# EasyEDA Pro project Iot-Whgm5开发板.eprj, schematic Schematic1

## Sheets
1 P1: Create Date: 2024-05-17; Page Name: P1.Schematic1; Project Name: Iot-Whgm5开发板; Schematic Name: Schematic1; Update Date: 2024-06-14; Company: 嘉立创EDA; Drawed: 潘世俊; Page Size: A4; Version: V1.0
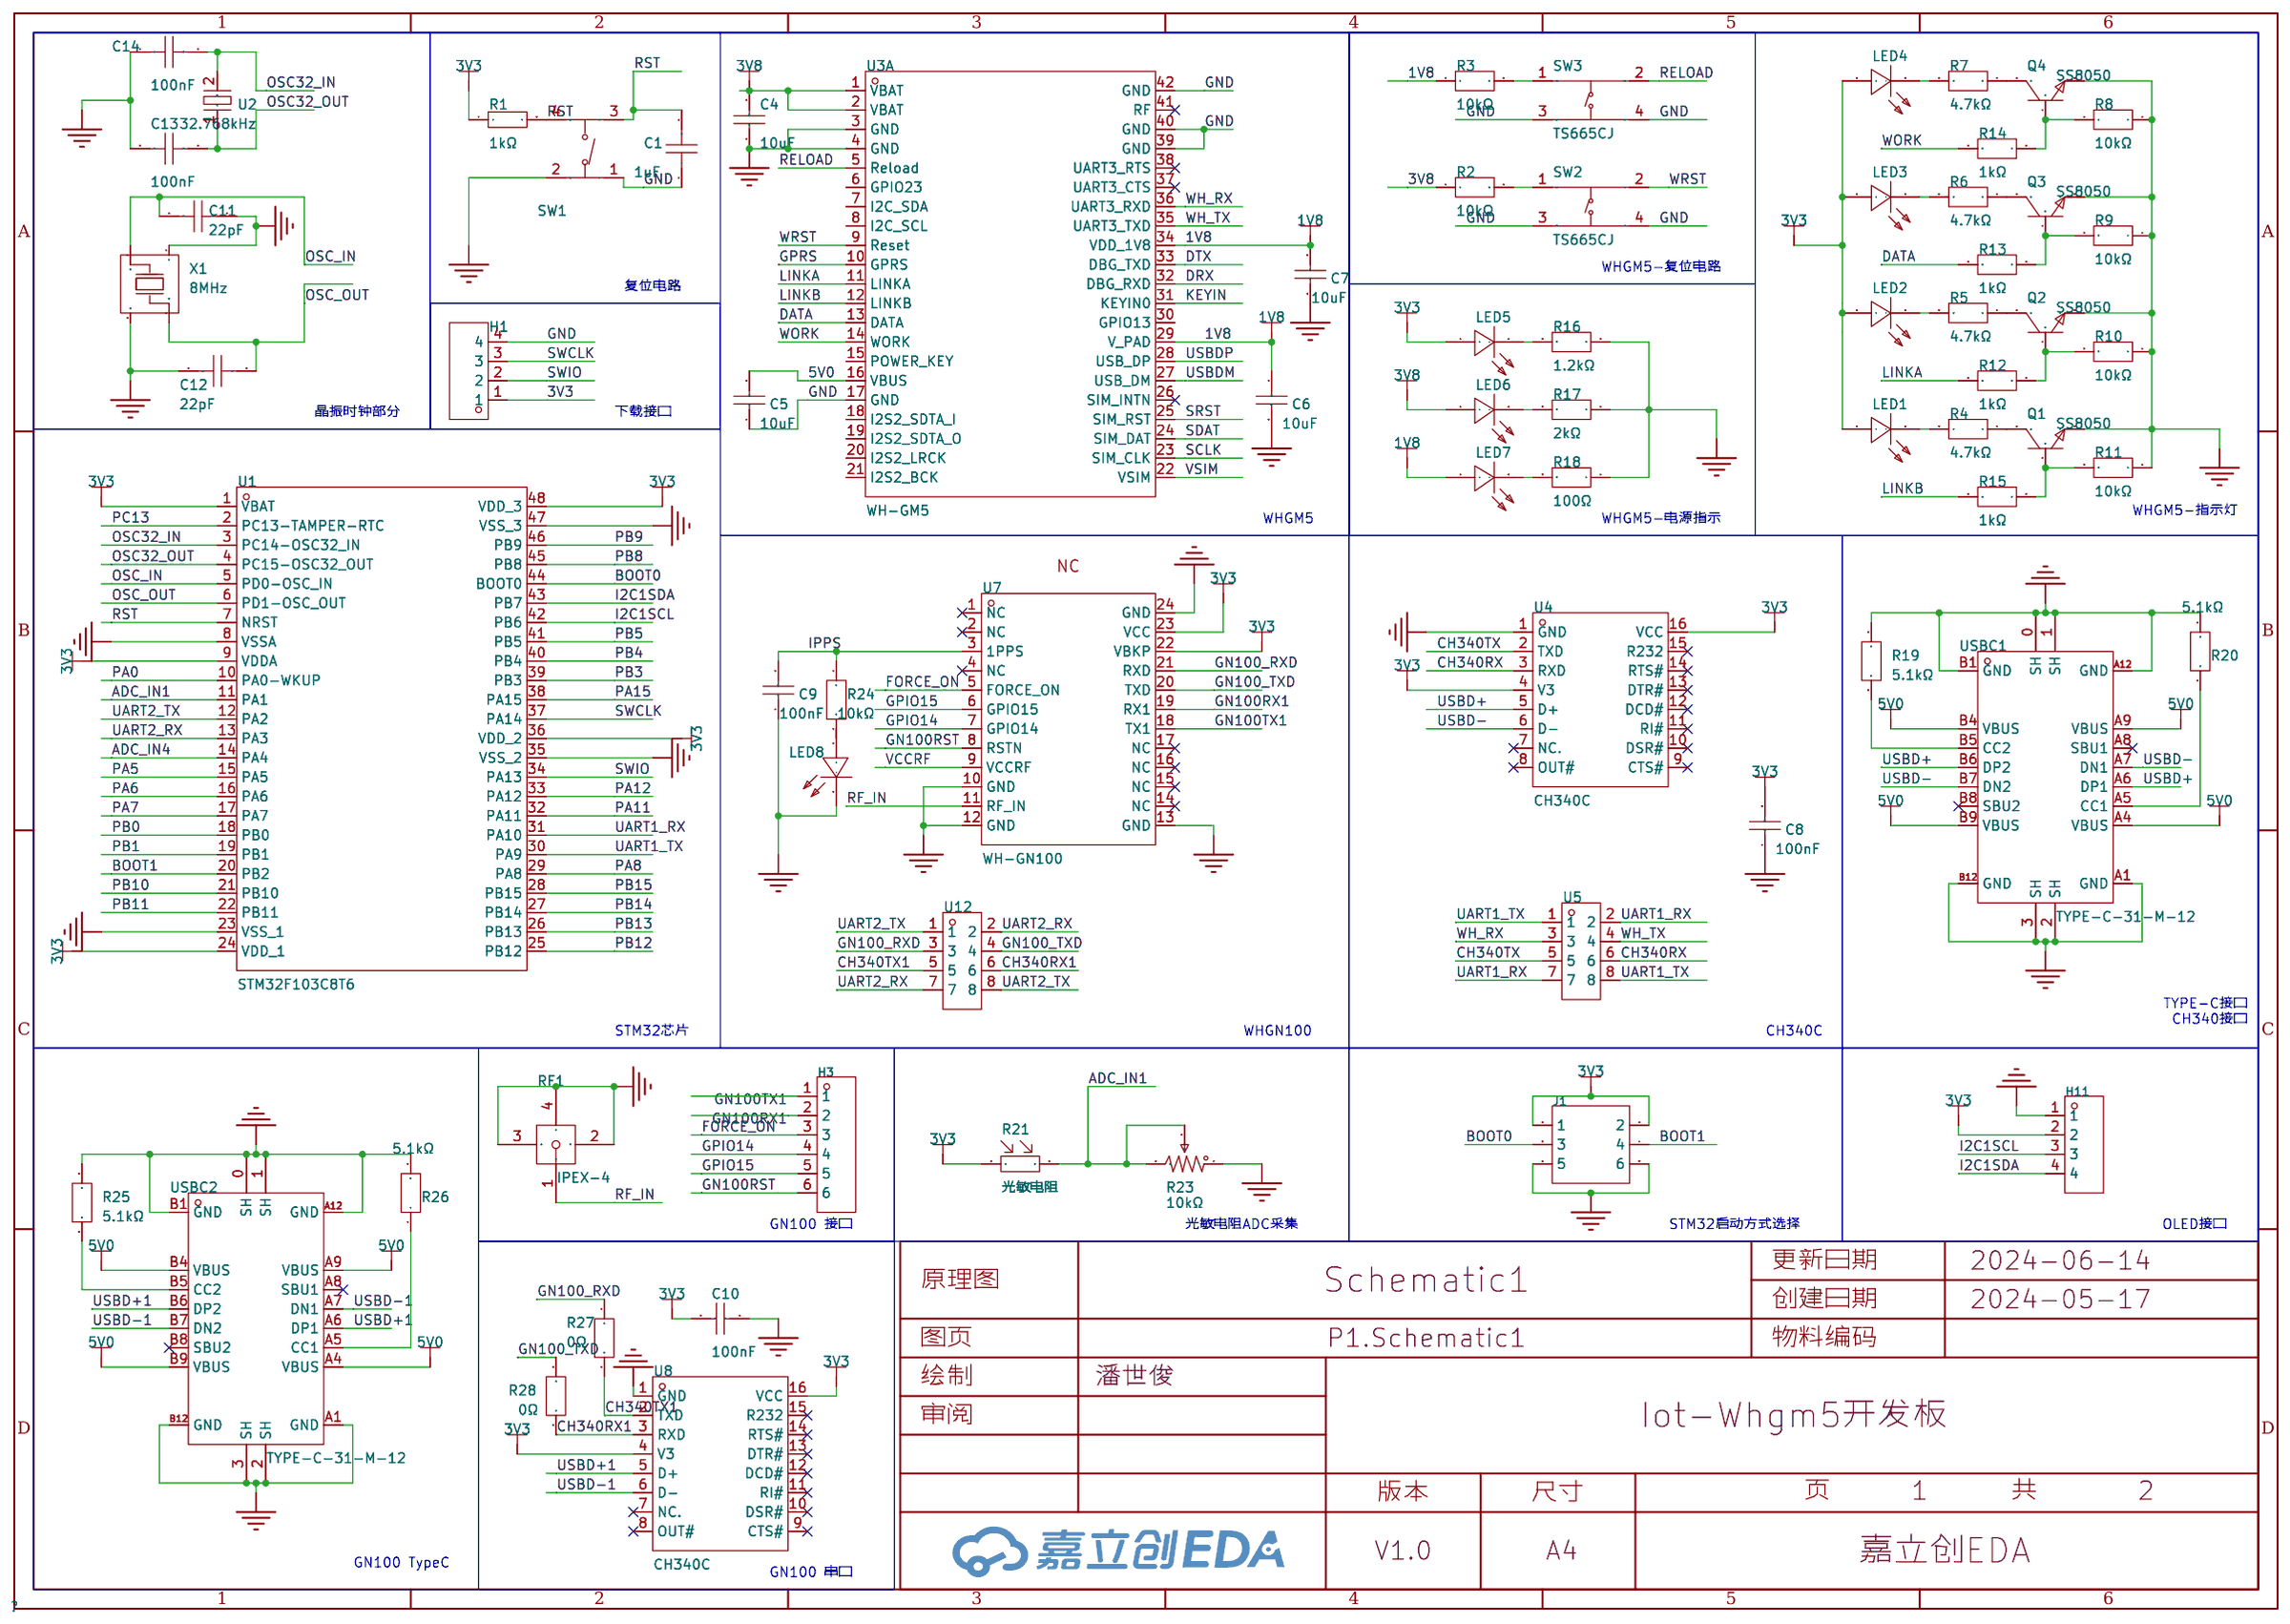
[diagram p0: P1]
2 P2: Page Name: P2.Schematic1; Update Date: 2024-05-18
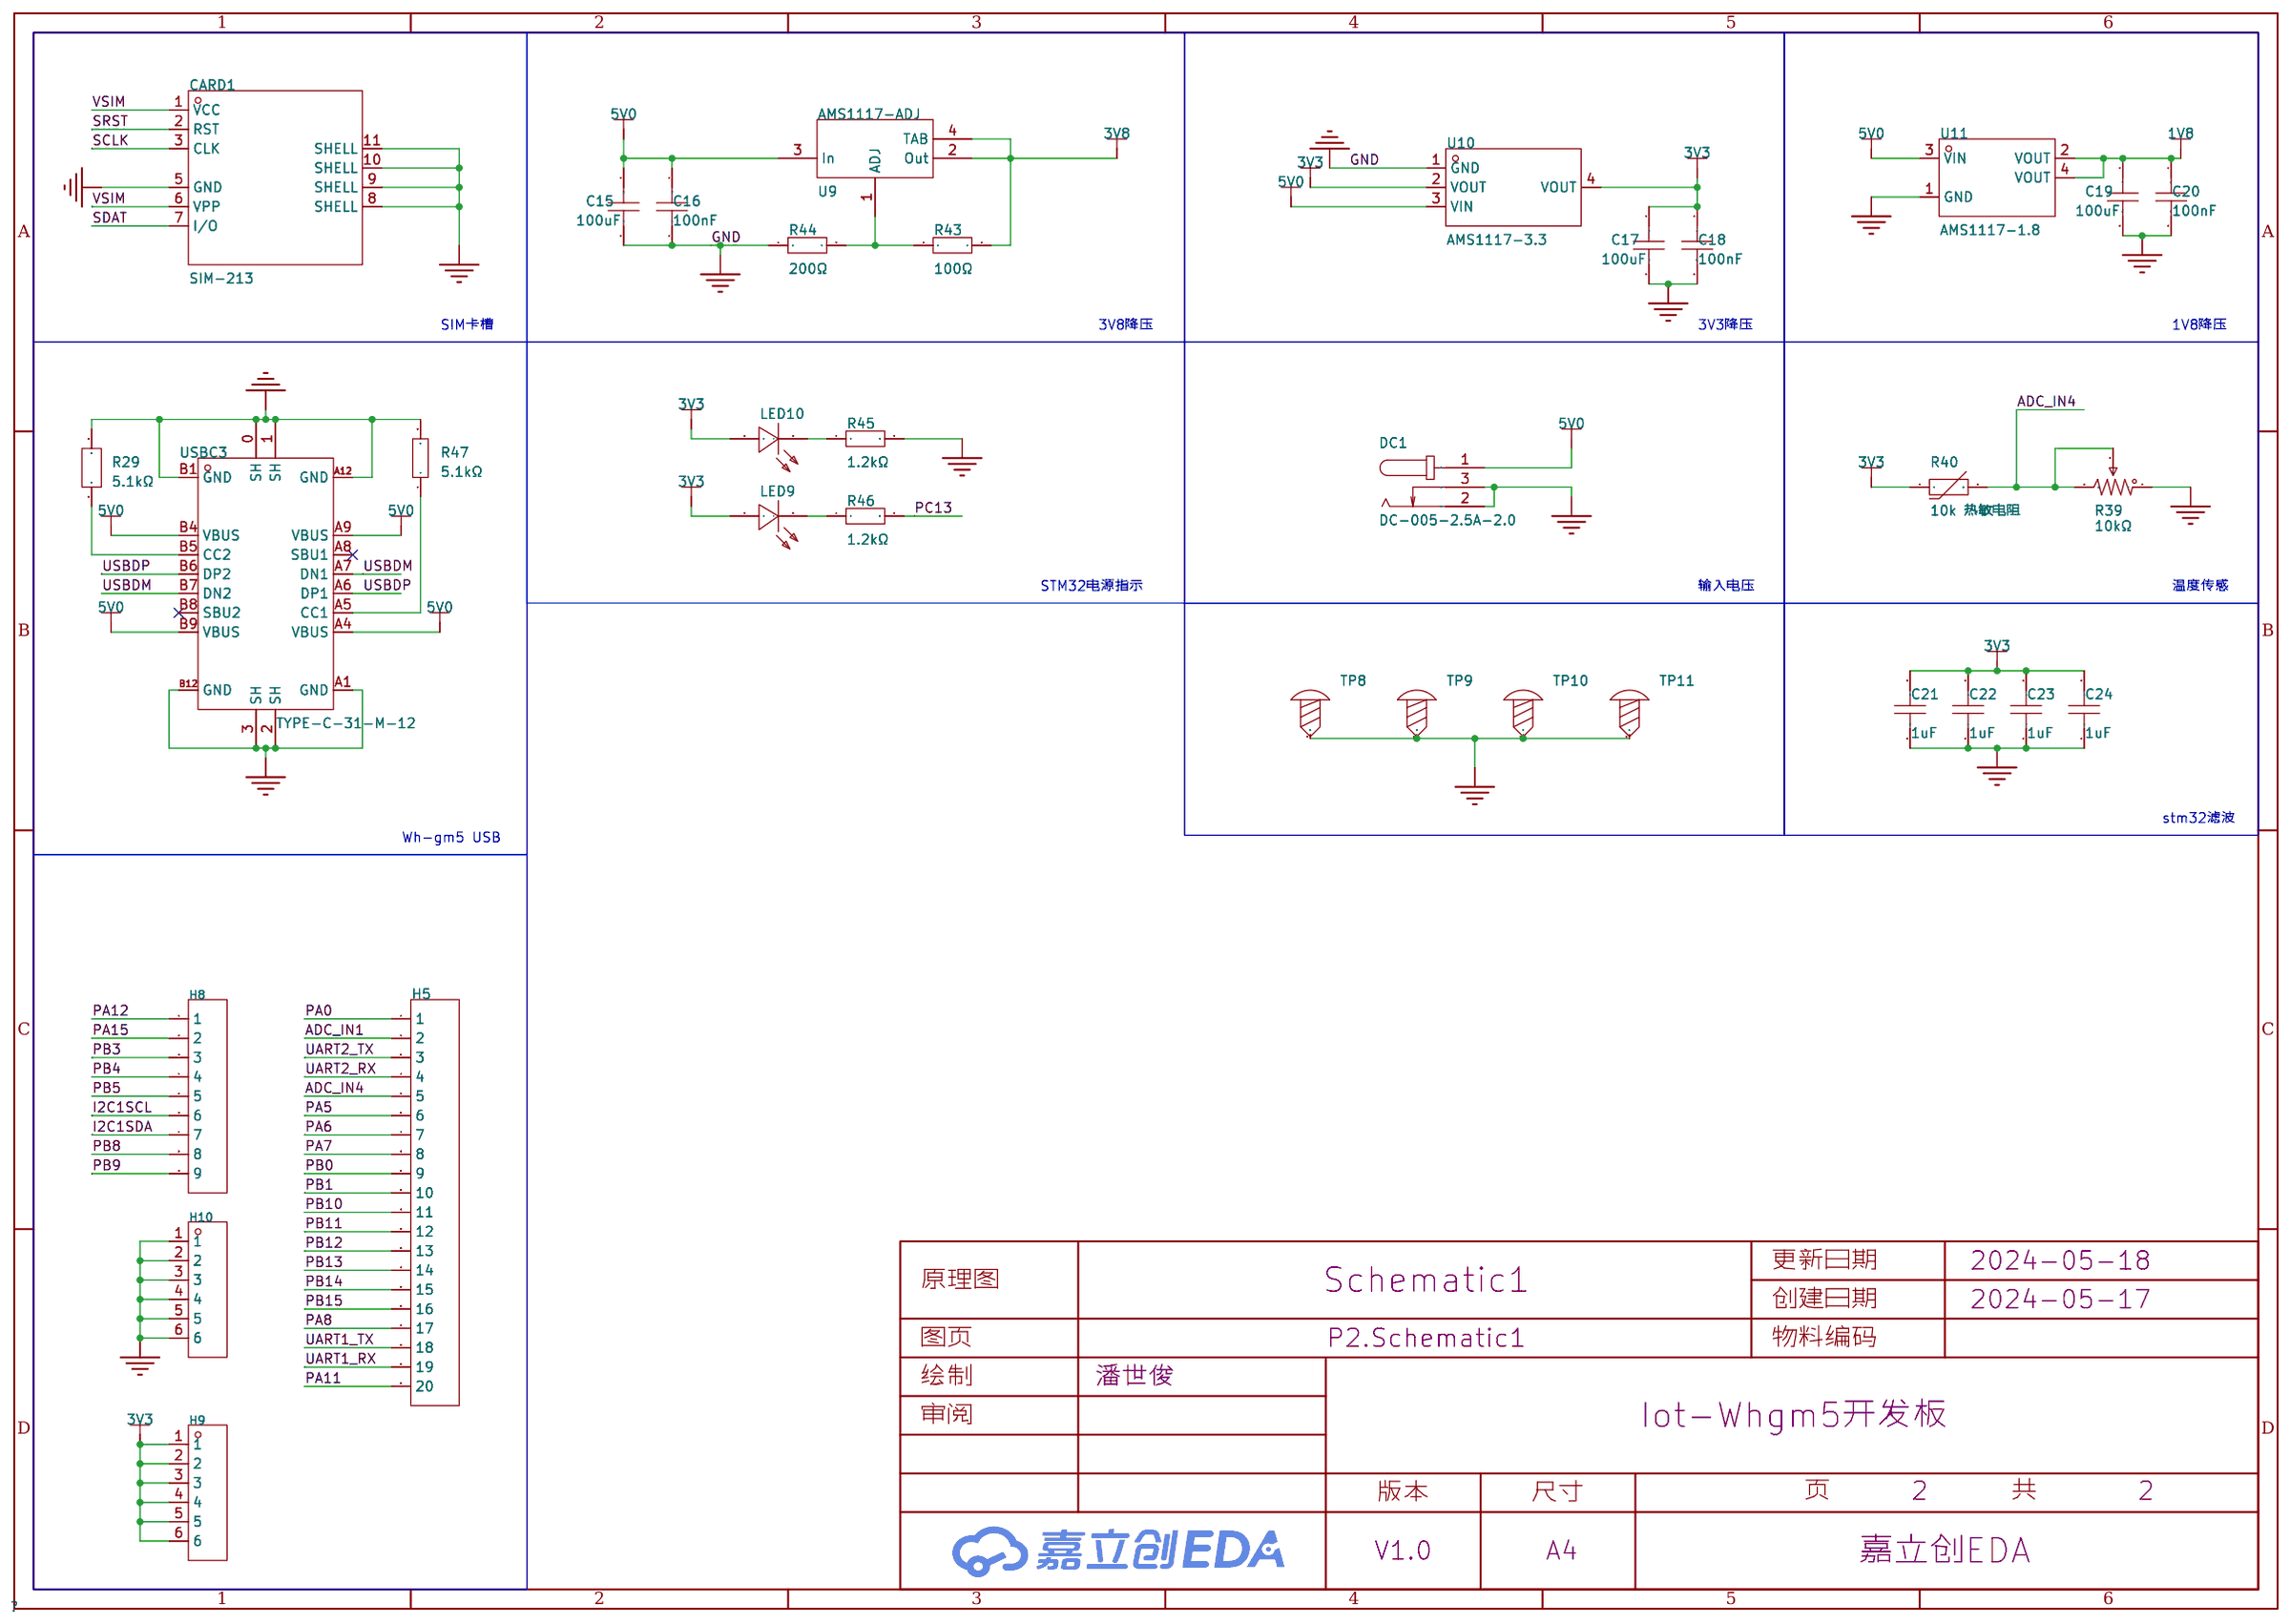
[diagram p1: P2]

## Parts
sheet P1
C1  1uF  [C0805]
C4  10uF  [D0805]
C5  10uF  [D0805]
C6  10uF  [D0805]
C7  10uF  [D0805]
C8  100nF  [D0805]
C9  100nF  [D0805]
C10  100nF  [D0805]
C11  22pF  [C0805]
C12  22pF  [C0805]
C13  100nF  [C0805]
C14  100nF  [C0805]
H1  PZ254V-11-04P  [HDR-TH_4P-P2.54-V-M]
H3  -  [HDR-TH_6P-P2.54-V-F]
H11  -  [HDR-TH_4P-P2.54-V-F]
J1  2.54-2*3P针  [HDR-TH_6P-P2.54-V-M-R2-C3-S2.54-1]
LED1  NCD0805R1  [LED0805-R-RD]
LED2  NCD0805R1  [LED0805-R-RD]
LED3  NCD0805R1  [LED0805-R-RD]
LED4  NCD0805R1  [LED0805-R-RD]
LED5  NCD0805R1  [LED0805-R-RD]
LED6  NCD0805R1  [LED0805-R-RD]
LED7  NCD0805R1  [LED0805-R-RD]
LED8  NCD0805R1  [LED0805-R-RD]
Q1  SS8050  [SOT-23-3_L2.9-W1.3-P1.90-LS2.4-BR]
Q2  SS8050  [SOT-23-3_L2.9-W1.3-P1.90-LS2.4-BR]
Q3  SS8050  [SOT-23-3_L2.9-W1.3-P1.90-LS2.4-BR]
Q4  SS8050  [SOT-23-3_L2.9-W1.3-P1.90-LS2.4-BR]
R1  1kΩ  [R0805]
R2  10kΩ  [R0805]
R3  10kΩ  [R0805]
R4  4.7kΩ  [R0805]
R5  4.7kΩ  [R0805]
R6  4.7kΩ  [R0805]
R7  4.7kΩ  [R0805]
R8  10kΩ  [R0805]
R9  10kΩ  [R0805]
R10  10kΩ  [R0805]
R11  10kΩ  [R0805]
R12  1kΩ  [R0805]
R13  1kΩ  [R0805]
R14  1kΩ  [R0805]
R15  1kΩ  [R0805]
R16  1.2kΩ  [R0805]
R17  2kΩ  [R0805]
R18  100Ω  [R0805]
R19  5.1kΩ  [R0805]
R20  5.1kΩ  [R0805]
R21  光敏电阻  [RES-TH_L5.1-W4.3-P3.40-D0.5]
R23  10kΩ  [RES-ADJ-SMD_3P-L3.0-W3.8-P1.75-BR]
R24  10kΩ  [R0805]
R25  5.1kΩ  [R0805]
R26  5.1kΩ  [R0805]
R27  0Ω  [R0805]
R28  0Ω  [R0805]
RF1  IPEX-4  [IPEX-SMD_4P-L1.8-W1.7-LS2.0]
SW1  TS-1187A-B-A-B  [SW-SMD_4P-L5.1-W5.1-P3.70-LS6.5-TL-2]
SW2  TS665CJ  [SW-TH_4P-L6.0-W6.0-P4.50-LS6.5]
SW3  TS665CJ  [SW-TH_4P-L6.0-W6.0-P4.50-LS6.5]
U1  STM32F103C8T6  [LQFP-48_L7.0-W7.0-P0.50-LS9.0-BL]
U2  32.768kHz  [CRYSTAL-SMD_L3.2-W1.5-1]
U3  WH-GM5  [LCC-LGA-81_L28.1-W24.5-P1.27-TL]  (section 1)
U4  CH340C  [SOP-16_L10.0-W3.9-P1.27-LS6.0-BL]
U5  PZ2.54-2*4  [HDR-TH_8P-P2.54-V-M-R2-C4-S2.54]
U7  WH-GN100  [GPSM-SMD_WH-GN100]
U8  CH340C  [SOP-16_L10.0-W3.9-P1.27-LS6.0-BL]
U12  PZ2.54-2*4  [HDR-TH_8P-P2.54-V-M-R2-C4-S2.54]
USBC1  TYPE-C-31-M-12  [USB-C_SMD-TYPE-C-31-M-12]
USBC2  TYPE-C-31-M-12  [USB-C_SMD-TYPE-C-31-M-12]
X1  8MHz  [OSC-SMD_4P-L3.2-W2.5-BL]
sheet P2
C15  100uF  [C0805]
C16  100nF  [C0805]
C17  100uF  [C0805]
C18  100nF  [C0805]
C19  100uF  [C0805]
C20  100nF  [C0805]
C21  1uF  [C0805]
C22  1uF  [C0805]
C23  1uF  [C0805]
C24  1uF  [C0805]
CARD1  SIM-213  [SIM-SMD_SIM-213_C2836124]
DC1  DC-005-2.5A-2.0  [CONN-TH_DC-005-2.5A-2.0]
H5  -  [HDR-TH_20P-P2.54-V-F]
H8  -  [HDR-TH_9P-P2.54-V-F-1]
H9  -  [HDR-TH_6P-P2.54-V-F]
H10  -  [HDR-TH_6P-P2.54-V-F]
LED9  NCD0805R1  [LED0805-R-RD]
LED10  NCD0805R1  [LED0805-R-RD]
R29  5.1kΩ  [R0805]
R39  10kΩ  [RES-ADJ-SMD_3P-L3.0-W3.8-P1.75-BR]
R40  10k 热敏电阻  [R0805]
R43  100Ω  [R0805]
R44  200Ω  [R0805]
R45  1.2kΩ  [R0805]
R46  1.2kΩ  [R0805]
R47  5.1kΩ  [R0805]
TP8  -  [M2螺丝]
TP9  -  [M2螺丝]
TP10  -  [M2螺丝]
TP11  -  [M2螺丝]
U9  AMS1117-ADJ  [SOT-223_L6.7-W3.5-P2.30-BR]
U10  AMS1117-3.3  [SOT-223-3_L6.5-W3.4-P2.30-LS7.0-BR]
U11  AMS1117-1.8  [SOT-223-3_L6.7-W3.7-P2.30-LS7.0-BR]
USBC3  TYPE-C-31-M-12  [USB-C_SMD-TYPE-C-31-M-12]

## Library data of the parts
C1 = CC0805KRX7R9BB103: 容值:10nF;精度:±10%;额定电压:50V;材质(温度系数):X7R;; LCSC Part Name: 10nF ±10% 50V; Supplier Part: C83170; Manufacturer: YAGEO(国巨); Supplier Footprint: 0805; JLCPCB Part Class: 扩展库; Datasheet: https://atta.szlcsc.com/upload/public/pdf/source/20170211/1486785656773.pdf; Supplier: LCSC; Tolerance: ±10%; Voltage Rated: 50V; Temperature Coefficient: X7R
C4-C10 = CL31A106KBHNNNE: 容值:10uF;精度:±10%;额定电压:50V;材质(温度系数):X5R;; LCSC Part Name: 10uF ±10% 50V; Supplier Part: C13585; Manufacturer: SAMSUNG(三星); Supplier Footprint: 1206; JLCPCB Part Class: 基础库; Datasheet: https://atta.szlcsc.com/upload/public/pdf/source/20160218/1457707763339.pdf; Supplier: LCSC; Tolerance: ±10%; Voltage Rated: 50V; Temperature Coefficient: X5R
C11-C24 = CAP_0805: Supplier Footprint: 0805
H1 = PZ254V-11-04P: 插针结构:1x4P;间距:2.54mm;行距:-;圆针/方针:方针;安装类型:直插;排数:单排;总PIN位数:4P;额定电流:3A;额定电压:250V;配合针长度:6mm;塑高:2.5mm;端接针长度:3mm;触头材质:-;工作温度范围:-40℃~+105℃;颜色:黑色;; LCSC Part Name: 间距:2.54mm 1x4P 直插 方针; Supplier Part: C2691448; Manufacturer: XFCN(兴飞); Supplier Footprint: 插件,P=2.54mm; JLCPCB Part Class: 扩展库; Datasheet: https://atta.szlcsc.com/upload/public/pdf/source/20200309/C492403_F9F19131791D08044AD4F84F8E751A34.pdf; Supplier: LCSC; Pin Structure: 1x4P; Pitch: 2.54mm; Circluar Pins/Square Pins: 方针; Mounting Type: 直插; Number of Rows: 单排; Number of Pins: 4P; Current Rating (Max): 3A; Voltage Rating (Max): 250V; Length of Mating Pin: 6mm; Insulation Height: 2.5mm; Length of End Connection Pin: 3mm; Operating Temperature Range: -40℃~+105℃; Color: 黑色
H3 H9 H10 = HDR-F_2.54_1x6P: Supplier Part: C40877; Supplier Footprint: 插件
H11 = HDR-F_2.54_1x4P: Supplier Part: C2718488; Supplier Footprint: 插件
J1 = 2.54-2*3P针: 插针结构:-;间距:2.54mm;行距:-;圆针/方针:-;安装类型:直插;排数:双排;总PIN位数:6P;额定电流:-;额定电压:-;配合针长度:-;塑高:-;触头材质:-;触头镀层:-;颜色:黑色;; LCSC Part Name: 间距:2.54mm 直插; Supplier Part: C65114; Manufacturer: BOOMELE(博穆精密); Supplier Footprint: 插件,P=2.54mm; JLCPCB Part Class: 扩展库; Supplier: LCSC; Pitch: 2.54mm; Mounting Type: 直插; Number of Rows: 双排; Number of Pins: 6P; Color: 黑色
LED1-LED10 = NCD0805R1: 灯头类型:-;发光颜色:红色;正向电压(VF):1.6V~2.6V;功率:65mW;正向电流:20mA;主波长:615nm~630nm;二极管配置:独立二极管;透镜颜色:无色透明透镜;色温:-;发光强度:67mcd~195mcd;发光角度:130°;载带方式:-;工作温度:-30℃~+85℃;; Supplier Part: C84256; Manufacturer: 国星光电; Supplier Footprint: 0805; JLCPCB Part Class: 基础库; Datasheet: https://atta.szlcsc.com/upload/public/pdf/source/20200820/C84256_F0A75A43B3EAD75808600A0514C76B99.pdf; Supplier: LCSC; Emitted Color: 红色; Forward Voltage (VF): 1.6V~2.6V; Power Dissipation: 65mW; Forward Current: 20mA; Dominant Wavelength: 615nm~630nm; Diode Configuration: 独立二极管; Lens Color: 无色透明透镜; Luminous Intensity: 67mcd~195mcd; Viewing Angle: 130°; Operating Temperature: -30℃~+85℃
Q1-Q4 = SS8050_C2150: 晶体管类型:NPN;集电极电流(Ic):1.5A;集射极击穿电压(Vceo):25V;功率(Pd):300mW;直流电流增益(hFE@Ic,Vce):200@100mA,1V;; LCSC Part Name: SS8050(RANGE:200-350) hfe=200~350; Supplier Part: C2150; Manufacturer: CJ(江苏长电/长晶); Supplier Footprint: SOT-23; JLCPCB Part Class: 基础库; Datasheet: https://atta.szlcsc.com/upload/public/pdf/source/20230322/AEE86F4B043774EFF80CAEA14A37D9E9.pdf; Supplier: LCSC; Transistor Type: NPN; Collector Current (Ic): 1.5A; Collector-Emitter Breakdown Voltage (Vceo): 25V; Power Dissipation (Pd): 300mW; DC Current Gain (hFE@Ic,Vce): 200@100mA,1V; Transition Frequency (fT): 100MHz; Collector Cut-Off Current (Icbo): 100nA; Collector-Emitter Saturation Voltage (VCE(sat)@Ic,Ib): 500mV@800mA,80mA
R1 = RC0603FR-071KL: 电阻类型:厚膜电阻;阻值:1kΩ;精度:±1%;功率:100mW;最大工作电压:75V;温度系数:±100ppm/℃;; LCSC Part Name: 厚膜电阻 1kΩ ±1% 100mW; Supplier Part: C22548; Manufacturer: YAGEO(国巨); Supplier Footprint: 0603; JLCPCB Part Class: 扩展库; Datasheet: https://atta.szlcsc.com/upload/public/pdf/source/20180316/70C0E2BDAE7FCC62C531A5A58D202EE1.pdf; Supplier: LCSC; Type: 厚膜电阻; Tolerance: ±1%; Power(Watts): 100mW; Overload Voltage (Max): 75V; Temperature Coefficient: ±100ppm/℃; Operating Temperature Range: -55℃~+155℃
R2-R20 R24-R29 = MF1/4W-10K±1%-ST52: 电阻类型:金属膜电阻;阻值:10kΩ;精度:±1%;功率:250mW;温度系数:±100ppm/℃;; LCSC Part Name: 金属膜电阻 10kΩ ±1% 250mW; Supplier Part: C2903232; Manufacturer: VO(翔胜); Supplier Footprint: 插件,2.7x6.2mm; JLCPCB Part Class: 扩展库; Datasheet: https://atta.szlcsc.com/upload/public/pdf/source/20200609/C601728_5AA4C0C8E12E11069DA2C3356F29D1F2.pdf; Supplier: LCSC; Type: 金属膜电阻; Tolerance: ±1%; Overload Voltage (Max): 250V; Power(Watts): 250mW; Temperature Coefficient: ±100ppm/℃; Operating Temperature Range: -55℃~+155℃
R21 = GL5528(10-20)_C10081: 暗电阻:1MΩ;亮电阻 @ 10Lux:10kΩ~20kΩ;光谱峰值(波长):540nm;; LCSC Part Name: 亮电阻:10kΩ~20kΩ 暗电阻:1MΩ; Supplier Part: C10081; Manufacturer: JCHL(晶创和立); Manufacturer Part: GL5528(10-20); Supplier Footprint: 插件,P=3.4mm; JLCPCB Part Class: 扩展库; Datasheet: https://atta.szlcsc.com/upload/public/pdf/source/20200417/C515010_C10502EF7F431E893A7F20DB83F527F0.pdf; Supplier: LCSC; Dark Resistance: 1MΩ; Illuminated Resistance @ 10Lux: 10kΩ~20kΩ; Applied Voltage: 150V; Spectral Peak: 540nm
R23 R39 = TC33X-2-103E: 阻值:10kΩ;精度:±25%;功率:150mW;温度系数:±250ppm/℃;; LCSC Part Name: 10kΩ ±25%; Supplier Part: C719176; Manufacturer: BOURNS; Supplier Footprint: SMD; JLCPCB Part Class: 扩展库; Datasheet: https://atta.szlcsc.com/upload/public/pdf/source/20200810/C720646_BB66A75E654D5E1D30127FF45BCD3C26.pdf; Supplier: LCSC; Tolerance: ±25%; Power(Watts): 150mW; Temperature Coefficient: ±250ppm/℃; Turns: 1
RF1 = IPEX-4: 射频系列:IPEX;; LCSC Part Name: IPEX; Supplier Part: C2987683; Manufacturer: Ziisor(致哲); Supplier Footprint: SMD; JLCPCB Part Class: 扩展库; Datasheet: https://atta.szlcsc.com/upload/public/pdf/source/20220330/D1F8CE2CB9E7BFF3BB2C4079325448CF.pdf; Supplier: LCSC; RF Series: IPEX
SW1 = TS-1187A-B-A-B: 电路结构:单刀单掷;按钮形状:圆形按钮;作用力:160gf;安装方式:立贴;开关长度:5.1mm;开关宽度:5.1mm;开关高度:1.5mm;带支架:不带;触点电流:50mA;额定电压(DC):12V;绝缘电阻:-;带灯:无;机械寿命:10万次;; LCSC Part Name: 5.1*5.1*1.5mm 立贴 轻触开关; Supplier Part: C318884; Manufacturer: XKB Connectivity(中国星坤); Supplier Footprint: SMD; JLCPCB Part Class: 基础库; Datasheet: https://atta.szlcsc.com/upload/public/pdf/source/20200227/C318890_053E50208A88A7BA1965D8746000774E.pdf; Supplier: LCSC; Circuit: 单刀单掷; Actuator Style: 圆形按钮; Operating Force: 160gf; Mounting Style: 立贴; Switch Length: 5.1mm; Switch Width: 5.1mm; Switch Height: 1.5mm; Strike Gundam: 不带; Contact Current: 50mA; Voltage Rating (DC): 12V; Actuator/Cap Color: 金色; With Lamp: 无; Mechanical Life: 10万次; Operating Temperature: -30℃~+85℃
SW2 SW3 = TS665CJ: 电路结构:单刀单掷;按钮形状:圆形按钮;安装方式:直插;开关长度:6mm;开关宽度:6mm;开关高度:5mm;触点电流:50mA;额定电压(DC):12V;带灯:-;机械寿命:-;; LCSC Part Name: 6*6*5mm 直插 轻触开关; Supplier Part: C393938; Manufacturer: SHOU HAN(首韩); Supplier Footprint: 插件; JLCPCB Part Class: 扩展库; Datasheet: https://atta.szlcsc.com/upload/public/pdf/source/20190521/C393938_BDABEAC600B4C55E200A80AA129B70BC.pdf; Supplier: LCSC; Circuit: 单刀单掷; Actuator Style: 圆形按钮; Mounting Style: 直插; Switch Length: 6mm; Switch Width: 6mm; Switch Height: 5mm; Contact Current: 50mA; Voltage Rating (DC): 12V
U1 = STM32F103C8T6: CPU内核:ARM-M3;程序存储容量:64KB;RAM总容量:20KB;GPIO端口数量:37;工作电压范围:2V~3.6V;CPU最大主频:72MHz;程序存储器类型:FLASH;; Supplier Part: C8734; Manufacturer: ST(意法半导体); Supplier Footprint: LQFP-48(7x7); JLCPCB Part Class: 扩展库; Datasheet: https://atta.szlcsc.com/upload/public/pdf/source/20220812/8363ACEC51AD55ECEB84799464F7CB85.pdf; Supplier: LCSC; CPU Core: ARM-M3; Program Storage Size: 64KB; RAM Size: 20KB; GPIO Ports Number: 37; Operating Voltage Range: 2V~3.6V; CPU Maximum Speed: 72MHz; Program Memory Type: FLASH; Operating Temperature Range: -40℃~+85℃; ADC (Bit): 12bit; Universal Serial Bus: 有; Peripheral/Function: 看门狗；DMA；看门狗；温度传感器; Watchdog: 有; Infrared Data Association: 有; Low-Voltage Detect: 有; Direct Memory Access: 有; Internal Oscillator: 有
U2 = H31003271C2070CY: 晶振类型:贴片晶振;频率:32.768kHz;常温频差:±20ppm;外接负载电容:12.5pF;频率稳定度(全温):±30ppm;; LCSC Part Name: 32.768kHz ±20ppm 12.5pF; Supplier Part: C5361379; Manufacturer: JGHC(晶光华); Supplier Footprint: SMD3215-2P; JLCPCB Part Class: 扩展库; Datasheet: https://atta.szlcsc.com/upload/public/pdf/source/20240223/DA6BB0D04F2F206220D58296EAF6160A.pdf; Supplier: LCSC; Crystal Type: 贴片晶振; Normal temperature Frequency Tolerance: ±20ppm; External load capacitor: 12.5pF; Frequency Stability(Full temperature range): ±30ppm; Equivalent Series Resistance (ESR): 70kΩ; Operating Temperature: -40℃~+85℃
U3 = WH-GM5_C2833613: LCSC Part Name: 提供 LCC/LGA 混合连接方式模块; Supplier Part: C2833613; Manufacturer: USR(有人物联网); JLCPCB Part Class: 扩展库; Datasheet: https://atta.szlcsc.com/upload/public/pdf/source/20210521/C2833613_BFDC8E35AC606A08B915FEA5419AEEFD.pdf; Supplier: LCSC
U4 U8 = CH340C: 应用功能:收发器;接口协议:USB 2.0;数据速率:2Mbps;; LCSC Part Name: CH340C USB转串口芯片 CH340; Supplier Part: C84681; Manufacturer: WCH(南京沁恒); Supplier Footprint: SOP-16; JLCPCB Part Class: 扩展库; Datasheet: https://atta.szlcsc.com/upload/public/pdf/source/20200819/C84681_ADBED554CE321879DBD6B1D06488689C.pdf; Supplier: LCSC; Applications Function: 收发器; Protocol: USB 2.0; Supply Voltage: 3.3V；5V; Data Rate: 2Mbps
U5 U12 = PZ2.54-2*4: 插针结构:2x4P;间距:2.54mm;排数:双排;总PIN位数:8P;; Supplier Part: C5156676; Manufacturer: ZHOURI(洲日); Supplier Footprint: 插件,P=2.54mm; JLCPCB Part Class: 扩展库; Datasheet: https://atta.szlcsc.com/upload/public/pdf/source/20220923/0E7A4A94740FFD503E2D73F36F92C1EA.pdf; Supplier: LCSC; Pin Structure: 2x4P; Pitch: 2.54mm; Number of Rows: 双排; Number of Pins: 8P
U7 = WH-GN100: Supplier Part: C9900013145; Supplier Footprint: SMD-24; JLCPCB Part Class: 扩展库; Supplier: LCSC
USBC1-USBC3 = TYPE-C-31-M-12: 连接器类型:Type-C;标准:-;公母:母;端口数量:1;触点数量:16P;安装方式:-;额定电流 - 电源:5A;触头材质:-;触头镀层:-;工作温度范围:-;焊接温度(最大值):-;; LCSC Part Name: Type-C 母; Supplier Part: C165948; Manufacturer: 韩国韩荣; Supplier Footprint: SMD; JLCPCB Part Class: 扩展库; Datasheet: https://atta.szlcsc.com/upload/public/pdf/source/20220525/466408E853115E789EDB0DDC29077C05.pdf; Supplier: LCSC; Connector Type: Type-C; Gender: 母; Number of Ports: 1; Number of Contacts: 16P; Current Rating - Power (Max): 5A
X1 = TAXM8M4RDBCCT2T: 晶振类型:贴片晶振;频率:8MHz;常温频差:±10ppm;外接负载电容:10pF;频率稳定度(全温):±15ppm;; LCSC Part Name: 8MHz ±10ppm 10pF; Supplier Part: C400090; Manufacturer: YJX(雅晶鑫); Supplier Footprint: SMD3225-4P; JLCPCB Part Class: 扩展库; Datasheet: https://atta.szlcsc.com/upload/public/pdf/source/20190626/C400090_CF95B89E745AFE4EF2E392EF8AC009D6.pdf; Supplier: LCSC; Crystal Type: 贴片晶振; Normal temperature Frequency Tolerance: ±10ppm; External load capacitor: 10pF; Frequency Stability(Full temperature range): ±15ppm; Equivalent Series Resistance (ESR): 250Ω; Operating Temperature: -40℃~+85℃
CARD1 = SIM-213_C2836124: 卡连接方式:拔插式;卡类型:MicroSIM卡;连接器类型:卡座;本体最大高度:1.5mm;触头材质:-;触头镀层:金;工作温度范围:-40℃~+85℃;焊接温度(最大值):260℃;; LCSC Part Name: 拔插式 MicroSIM卡 卡座; Supplier Part: C2836124; Manufacturer: HANBO(汉博); Supplier Footprint: SMD; JLCPCB Part Class: 扩展库; Datasheet: https://atta.szlcsc.com/upload/public/pdf/source/20230131/88FB45FA145E9CCC9FE4F43183D41841.pdf; Supplier: LCSC; Card Connection Mode: 拔插式; Card Type: MicroSIM卡; Connector Type: 卡座; Body Height (Max): 1.5mm; Contact Plating: 金; Operating Temperature Range: -40℃~+85℃; Soldering Temperature(Max): 260℃
DC1 = DC-005-2.5A-2.0: 连接器类型:DC电源插座;安装方式:面板安装;触点内径:2mm;触点外径:6.2mm;额定电流:2.5A;额定电压:24V;触头材质:黄铜;工作温度范围:-20℃~+70℃;焊接温度(最大值):260℃;; LCSC Part Name: DC电源插座 内径:2mm 外径:6.2mm; Supplier Part: C319099; Manufacturer: XKB Connection(中国星坤); Supplier Footprint: 插件; JLCPCB Part Class: 扩展库; Datasheet: https://atta.szlcsc.com/upload/public/pdf/source/20230410/3C172F25A51FCA230ABE6D36425CBB3B.pdf; Supplier: LCSC; Connector Type: DC电源插座; Mounting Style: 面板安装; Inside Contact Diameter: 2mm; Outside Contact Diameter: 6.2mm; Current Rating (Max): 2.5A; Voltage Rating (Max): 24V; Contact Material: 黄铜; Operating Temperature Range: -20℃~+70℃; Soldering Temperature(Max): 260℃
H5 = HDR-F_2.54_1x20P: Supplier Part: C50984; Supplier Footprint: 插件
H8 = HDR-F_2.54_1x9P: Supplier Part: C39576; Supplier Footprint: 插件
R40 = SDNT2012X103F3950FTF: 阻值(25℃):10kΩ;B值(25℃/50℃):3950K;电阻精度:±1%;功率:200mW;B值精度:±1%;最大稳态电流(25℃):440uA;; LCSC Part Name: 10kΩ 电阻精度:±1% 3950K; Supplier Part: C95968; Manufacturer: Sunlord(顺络); Supplier Footprint: 0805; JLCPCB Part Class: 扩展库; Datasheet: https://atta.szlcsc.com/upload/public/pdf/source/20210916/BF106A3565EDFEB141CB3E0EA3A661F8.pdf; Supplier: LCSC; Resistance @ 25℃: 10kΩ; B Constant (25℃/50℃): 3950K; Resistance Tolerance: ±1%; Power: 200mW; B Constant Tolerance: ±1%; Steady State Current (Max): 440uA; Operating Temperature: -55℃~+125℃
R43-R47 = Res_0805: Supplier Footprint: 0805
TP8-TP11 = M2螺丝: Supplier Footprint: 插件
U9 = AMS1117-ADJ_C6188: 输出类型:可调;最大输入电压:15V;输出电压:1.25V~11.75V;最大输出电流:800mA;电源纹波抑制比(PSRR):75dB@(120Hz);输出极性:正极;; LCSC Part Name: ADJ 输入15V 输出1.25V~11.75V 800mA; Supplier Part: C6188; Manufacturer: AMS; Supplier Footprint: SOT-223; JLCPCB Part Class: 扩展库; Datasheet: https://atta.szlcsc.com/upload/public/pdf/source/20120416/1457706470730.pdf; Supplier: LCSC; Output Type: 可调; Maximum Input Voltage: 15V; Output Voltage: 1.25V~11.75V; MAX Output Current: 800mA; Power Supply Rejection Ratio (PSRR): 75dB@(120Hz); Dropout Voltage: 1.3V@(800mA); Output Polarity: 正极; Number of Outputs: 1
U10 = AMS1117-3.3_C6186: 输出类型:固定;最大输入电压:-;输出电压:3.3V;最大输出电流:1A;电源纹波抑制比(PSRR):72dB@(120Hz);输出极性:正极;; LCSC Part Name: 输出3.3V 1A; Supplier Part: C6186; Manufacturer: AMS; Supplier Footprint: SOT-223-3; JLCPCB Part Class: 基础库; Datasheet: https://atta.szlcsc.com/upload/public/pdf/source/20180727/C6186_7A095716F0823C02F1997A905E26C086.pdf; Supplier: LCSC; Output Type: 固定; Output Voltage: 3.3V; MAX Output Current: 1A; Power Supply Rejection Ratio (PSRR): 72dB@(120Hz); Dropout Voltage: 1.3V@(800mA); Output Polarity: 正极; Number of Outputs: 1
U11 = AMS1117-1.8_C5250991: 输出类型：固定 输出极性：正 最大输入电压：18V 输出电压：1.8V~1.8V 输出电流：1A 电源纹波抑制比(PSRR)：60dB@(120Hz); Supplier Part: C5250991; Manufacturer: TWGMC(台湾迪嘉); Supplier Footprint: SOT-223-3L; JLCPCB Part Class: 扩展库; Datasheet: https://atta.szlcsc.com/upload/public/pdf/source/20221109/9B11858B06F84A71B95621B760185792.pdf; Supplier: LCSC

## Nets
1V8: C6.1 C7.1 C19.1 C20.1 LED7.1(+) R3.1 U3.29(V_PAD) U3.34(VDD_1V8) U11.2(VOUT) U11.4(VOUT)
3V3: C8.2 C10.2 C17.1 C18.1 C21.2 C22.2 C23.2 C24.2 H1.1 H9.1 H9.2 H9.3 H9.4 H9.5 H9.6 H11.2 J1.1 J1.2 LED1.1(+) LED2.1(+) LED3.1(+) LED4.1(+) LED5.1(+) LED9.1(+) LED10.1(+) R1.1 R21.1 R40.1 U1.1(VBAT) U1.9(VDDA) U1.24(VDD_1) U1.36(VDD_2) U1.48(VDD_3) U4.4(V3) U4.16(VCC) U7.22(VBKP) U7.23(VCC) U8.4(V3) U8.16(VCC) U10.2(VOUT) U10.4(VOUT)
3V8: C4.2 LED6.1(+) R2.1 R43.2 U3.1(VBAT) U3.2(VBAT) U9.2(Out) U9.4(TAB)
5V0: C5.2 C15.1 C16.1 DC1.1 U3.16(VBUS) U9.3(In) U10.3(VIN) U11.3(VIN) USBC1.A4(VBUS) USBC1.A9(VBUS) USBC1.B4(VBUS) USBC1.B9(VBUS) USBC2.A4(VBUS) USBC2.A9(VBUS) USBC2.B4(VBUS) USBC2.B9(VBUS) USBC3.A4(VBUS) USBC3.A9(VBUS) USBC3.B4(VBUS) USBC3.B9(VBUS)
GND: C1.1 C4.1 C5.1 C6.2 C7.2 C8.1 C9.1 C10.1 C11.1 C12.1 C13.2 C14.1 C15.2 C16.2 C17.2 C18.2 C19.2 C20.2 C21.1 C22.1 C23.1 C24.1 CARD1.5(GND) CARD1.8(SHELL) CARD1.9(SHELL) CARD1.10(SHELL) CARD1.11(SHELL) DC1.2 DC1.3 H1.4 H10.1 H10.2 H10.3 H10.4 H10.5 H10.6 H11.1 J1.5 J1.6 LED8.2(-) Q1.2(E) Q2.2(E) Q3.2(E) Q4.2(E) R8.1 R9.1 R10.1 R11.1 R16.1 R17.1 R18.1 R19.1 R20.2 R23.1 R25.1 R26.2 R29.1 R39.1 R44.1 R45.2 R47.2 RF1.2 RF1.3 RF1.4 SW1.1(A) SW1.2(B) SW2.3(C) SW2.4(D) SW3.3(C) SW3.4(D) TP8.1 TP9.1 TP10.1 TP11.1 U1.8(VSSA) U1.23(VSS_1) U1.35(VSS_2) U1.47(VSS_3) U3.3(GND) U3.4(GND) U3.17(GND) U3.39(GND) U3.40(GND) U3.42(GND) U4.1(GND) U7.10(GND) U7.12(GND) U7.13(GND) U7.24(GND) U8.1(GND) U10.1(GND) U11.1(GND) USBC1.0(SH) USBC1.1(SH) USBC1.2(SH) USBC1.3(SH) USBC1.A1(GND) USBC1.A12(GND) USBC1.B1(GND) USBC1.B12(GND) USBC2.0(SH) USBC2.1(SH) USBC2.2(SH) USBC2.3(SH) USBC2.A1(GND) USBC2.A12(GND) USBC2.B1(GND) USBC2.B12(GND) USBC3.0(SH) USBC3.1(SH) USBC3.2(SH) USBC3.3(SH) USBC3.A1(GND) USBC3.A12(GND) USBC3.B1(GND) USBC3.B12(GND) X1.2 X1.4
VCCRF: U7.9(VCCRF)
ADC_IN1: H5.2 R21.2 R23.2 R23.3 U1.11(PA1)
ADC_IN4: H5.5 R39.2 R39.3 R40.2 U1.14(PA4)
BOOT0: J1.3 U1.44(BOOT0)
BOOT1: J1.4 U1.20(PB2)
CH340RX: U4.3(RXD) U5.6
CH340RX1: R28.1 U8.3(RXD) U12.6
CH340TX: U4.2(TXD) U5.5
CH340TX1: R27.2 U8.2(TXD) U12.5
DATA: R13.2 U3.13(DATA)
DRX: U3.32(DBG_RXD)
DTX: U3.33(DBG_TXD)
FORCE_ON: H3.3 U7.5(FORCE_ON)
GN100_RXD: R27.1 U7.21(RXD) U12.3
GN100_TXD: R28.2 U7.20(TXD) U12.4
GN100RST: H3.6 U7.8(RSTN)
GN100RX1: H3.2 U7.19(RX1)
GN100TX1: H3.1 U7.18(TX1)
GPIO14: H3.4 U7.7(GPIO14)
GPIO15: H3.5 U7.6(GPIO15)
GPRS: U3.10(GPRS)
I2C1SCL: H8.6 H11.3 U1.42(PB6)
I2C1SDA: H8.7 H11.4 U1.43(PB7)
IPPS: C9.2 R24.1 U7.3(1PPS)
KEYIN: U3.31(KEYIN0)
LINKA: R12.2 U3.11(LINKA)
LINKB: R15.2 U3.12(LINKB)
OSC32_IN: C14.2 U1.3(PC14-OSC32_IN) U2.2(GND)
OSC32_OUT: C13.1 U1.4(PC15-OSC32_OUT) U2.1
OSC_IN: C11.2 U1.5(PD0-OSC_IN) X1.1
OSC_OUT: C12.2 U1.6(PD1-OSC_OUT) X1.3
PA0: H5.1 U1.10(PA0-WKUP)
PA5: H5.6 U1.15(PA5)
PA6: H5.7 U1.16(PA6)
PA7: H5.8 U1.17(PA7)
PA8: H5.17 U1.29(PA8)
PA11: H5.20 U1.32(PA11)
PA12: H8.1 U1.33(PA12)
PA15: H8.2 U1.38(PA15)
PB0: H5.9 U1.18(PB0)
PB1: H5.10 U1.19(PB1)
PB3: H8.3 U1.39(PB3)
PB4: H8.4 U1.40(PB4)
PB5: H8.5 U1.41(PB5)
PB8: H8.8 U1.45(PB8)
PB9: H8.9 U1.46(PB9)
PB10: H5.11 U1.21(PB10)
PB11: H5.12 U1.22(PB11)
PB12: H5.13 U1.25(PB12)
PB13: H5.14 U1.26(PB13)
PB14: H5.15 U1.27(PB14)
PB15: H5.16 U1.28(PB15)
PC13: R46.2 U1.2(PC13-TAMPER-RTC)
RELOAD: SW3.2(B) U3.5(Reload)
RF_IN: RF1.1 U7.11(RF_IN)
RST: C1.2 R1.2 SW1.3(C) SW1.4(D) U1.7(NRST)
SCLK: CARD1.3(CLK) U3.23(SIM_CLK)
SDAT: CARD1.7(I/O) U3.24(SIM_DAT)
SRST: CARD1.2(RST) U3.25(SIM_RST)
SWCLK: H1.3 U1.37(PA14)
SWIO: H1.2 U1.34(PA13)
UART1_RX: H5.19 U1.31(PA10) U5.2 U5.7
UART1_TX: H5.18 U1.30(PA9) U5.1 U5.8
UART2_RX: H5.4 U1.13(PA3) U12.2 U12.7
UART2_TX: H5.3 U1.12(PA2) U12.1 U12.8
USBD+: U4.5(D+) USBC1.A6(DP1) USBC1.B6(DP2)
USBD+1: U8.5(D+) USBC2.A6(DP1) USBC2.B6(DP2)
USBD-: U4.6(D-) USBC1.A7(DN1) USBC1.B7(DN2)
USBD-1: U8.6(D-) USBC2.A7(DN1) USBC2.B7(DN2)
USBDM: U3.27(USB_DM) USBC3.A7(DN1) USBC3.B7(DN2)
USBDP: U3.28(USB_DP) USBC3.A6(DP1) USBC3.B6(DP2)
VSIM: CARD1.1(VCC) CARD1.6(VPP) U3.22(VSIM)
WH_RX: U3.36(UART3_RXD) U5.3
WH_TX: U3.35(UART3_TXD) U5.4
WORK: R14.2 U3.14(WORK)
WRST: SW2.2(B) U3.9(Reset)
$1N2451: R3.2 SW3.1(A)
$1N2726: Q1.3(C) R4.1
$1N2765: Q2.3(C) R5.1
$1N2804: Q3.3(C) R6.1
$1N2899: Q4.3(C) R7.1
$1N2935: LED1.2(-) R4.2
$1N2943: LED2.2(-) R5.2
$1N2948: LED4.2(-) R7.2
$1N2949: LED3.2(-) R6.2
$1N3568: Q2.1(B) R10.2 R12.1
$1N3650: Q4.1(B) R8.2 R14.1
$1N3655: Q3.1(B) R9.2 R13.1
$1N3697: Q1.1(B) R11.2 R15.1
$1N3835: LED5.2(-) R16.2
$1N3918: LED6.2(-) R17.2
$1N4097: LED7.2(-) R18.2
$1N4826: R19.2 USBC1.B5(CC2)
$1N4873: R20.1 USBC1.A5(CC1)
$1N6955: LED8.1(+) R24.2
$1N7251: R25.2 USBC2.B5(CC2)
$1N7254: R26.1 USBC2.A5(CC1)
$2N1856: R29.2 USBC3.B5(CC2)
$2N1859: R47.1 USBC3.A5(CC1)
$2N3608: LED9.2(-) R46.1
$2N3829: LED10.2(-) R45.1
Net-(R2-2): R2.2 SW2.1(A)
Net-(R43-1): R43.1 R44.2 U9.1(ADJ)

Not connected (* = marked no-connect by the designer): U3 6(GPIO23) 7(I2C_SDA) 8(I2C_SCL) 15(POWER_KEY) 18(I2S2_SDTA_I) 19(I2S2_SDTA_O) 20(I2S2_LRCK) 21(I2S2_BCK) 26(SIM_INTN)* 30(GPIO13) 37(UART3_CTS)* 38(UART3_RTS)* 41(RF)*; U4 7(NC.)* 8(OUT#)* 9(CTS#)* 10(DSR#)* 11(RI#)* 12(DCD#)* 13(DTR#)* 14(RTS#)* 15(R232)*; U7 1(NC)* 2(NC)* 4(NC)* 14(NC)* 15(NC)* 16(NC)* 17(NC)*; U8 7(NC.)* 8(OUT#)* 9(CTS#)* 10(DSR#)* 11(RI#)* 12(DCD#)* 13(DTR#)* 14(RTS#)* 15(R232)*; USBC1 A8(SBU1)* B8(SBU2)*; USBC2 A8(SBU1)* B8(SBU2)*; USBC3 A8(SBU1)* B8(SBU2)*

## Notes on the sheets
sheet 1
- WHGM5-复位电路
- 复位电路
- 晶振时钟部分
- 下载接口
- WHGM5
- WHGM5-电源指示
- WHGM5-指示灯
- TYPE-C接口
  CH340接口
- STM32芯片
- WHGN100
- CH340C
- GN100 接口
- 光敏电阻ADC采集
- STM32启动方式选择
- OLED接口
- GN100 TypeC
- GN100 串口
sheet 2
- SIM卡槽
- 3V8降压
- 3V3降压
- 1V8降压
- STM32电源指示
- 输入电压
- 温度传感
- Wh-gm5 USB
- stm32滤波
